# EasyEDA Pro project FPGA-G1.eprj, schematic Schematic1, sheets 7 to 10 of 10 (continued)
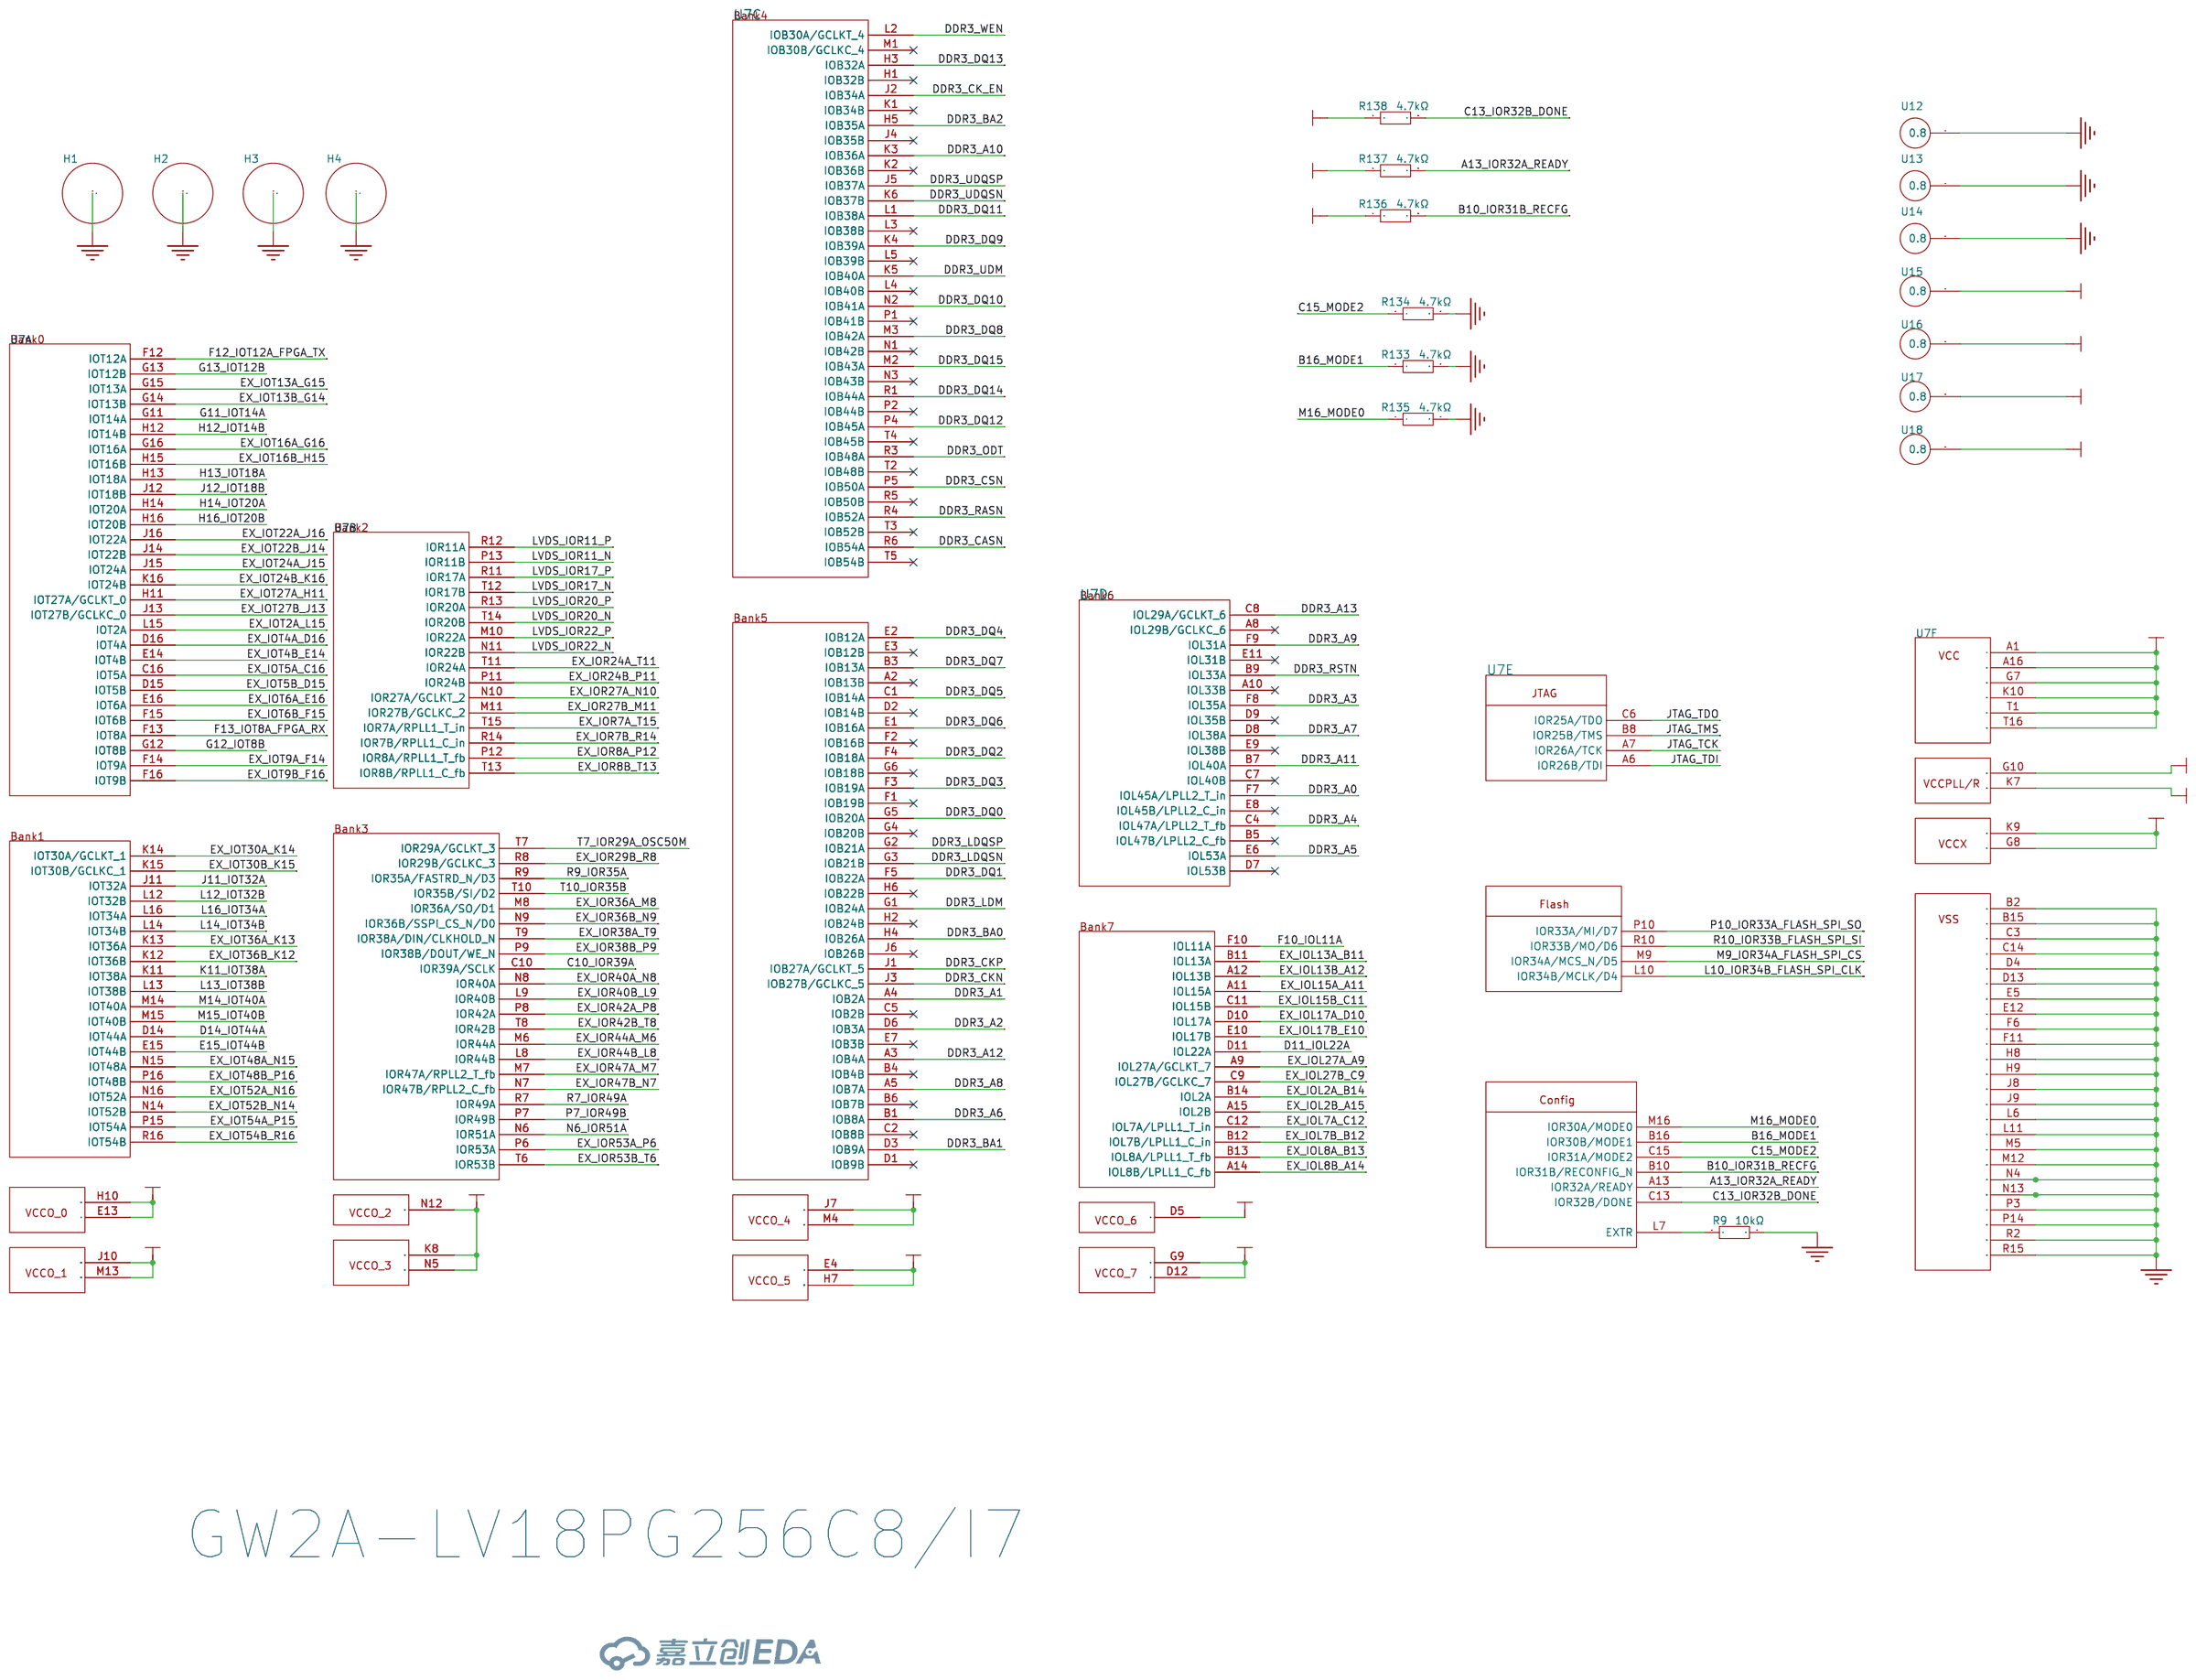
[diagram p0: FPGA]
## Library data of the parts
H5 H6 = 12251220ANG0S115001: 排数:双排;总PIN位数:40P;间距:2.54mm;插针结构:2x20P;行距:2.54mm;安装类型:直插;圆针/方针:方针;额定电流:3A;额定电压:-;配合针长度:6mm;塑高:2.5mm;端接针长度:3mm;触头材质:黄铜;触头镀层:-;工作温度范围:-40℃~+105℃;颜色:黑色;; LCSC Part Name: 2.54mm 2x20P 直插 方针; Supplier Part: C429965; Manufacturer: JILN(锦凌); Supplier Footprint: 插件,P=2.54mm; JLCPCB Part Class: 扩展库; Datasheet: https://atta.szlcsc.com/upload/public/pdf/source/20190920/C429965_BC46B4ED575BB92CEF1C6420E537C4AD.pdf; Supplier: LCSC; Number of Rows: 双排; Number of Pins: 40P; Pitch: 2.54mm; Pin Structure: 2x20P; Row Spacing: 2.54mm; Mounting Type: 直插; Circluar Pins/Square Pins: 方针; Current Rating (Max): 3A; Length of Mating Pin: 6mm; Insulation Height: 2.5mm; Length of End Connection Pin: 3mm; Contact Material: 黄铜; Operating Temperature Range: -40℃~+105℃; Color: 黑色
C22 C27 C91 C92 C114-C116 C118 C123 C124 C128 C132 C143-C147 C154-C159 C164-C173 = CL05B104KO5NNNC: 容值:100nF;精度:±10%;额定电压:16V;材质(温度系数):X7R;; LCSC Part Name: 100nF ±10% 16V; Supplier Part: C1525; Manufacturer: SAMSUNG(三星); Supplier Footprint: 0402; JLCPCB Part Class: 基础库; Datasheet: https://atta.szlcsc.com/upload/public/pdf/source/20160218/1457707763339.pdf; Supplier: LCSC; Tolerance: ±10%; Voltage Rated: 16V; Temperature Coefficient: X7R
CARD2 = TF PUSH: 卡类型:MicroSD卡(TF卡);连接器类型:卡座;卡连接方式:自弹式;本体最大高度:2mm;工作温度范围:-20℃~+90℃;; LCSC Part Name: 自弹式TF卡座 TF外焊式内存卡卡座; Supplier Part: C393941; Manufacturer: SHOU HAN(首韩); Supplier Footprint: SMD; JLCPCB Part Class: 扩展库; Datasheet: https://atta.szlcsc.com/upload/public/pdf/source/20191011/C393941_0DDD896EE907FEB750D8B7B8982E2A67.pdf; Supplier: LCSC; Card Type: MicroSD卡(TF卡); Connector Type: 卡座; Card Connection Mode: 自弹式; Maximum Body Height: 2mm; Operating Temperature Range: -20℃~+90℃
D11 = RCLAMP0524P_C907837: Supplier Part: C907837; Manufacturer: TECH PUBLIC(台舟); Supplier Footprint: DFN2510-10; JLCPCB Part Class: Extended Part; Datasheet: https://atta.szlcsc.com/upload/public/pdf/source/20210810/AE3DE9AC94AD2A317FD9BEA10653400F.pdf; Supplier: LCSC
C1 C2 = 0402CG180J500NT: 容值:18pF;精度:±5%;额定电压:50V;材质(温度系数):C0G;; LCSC Part Name: 18pF ±5% 50V; Supplier Part: C1549; Manufacturer: FH(风华); Supplier Footprint: 0402; JLCPCB Part Class: 基础库; Datasheet: https://atta.szlcsc.com/upload/public/pdf/source/20200305/C486355_26A10D38EF8C2A5C37091D0039909270.pdf; Supplier: LCSC; Tolerance: ±5%; Voltage Rated: 50V; Temperature Coefficient: C0G
CN1 = WAFER-100W-6A: 参考系列:-;间距:1mm;插针结构:1x6P;排数:1;每排PIN数:6;行距:-;公母:公型插针;安装方式:卧贴;额定电流:1A;工作温度范围:-25℃~+85℃;; LCSC Part Name: 间距:1mm 1x6P 卧贴; Supplier Part: C2874473; Manufacturer: HANBO(汉博); Supplier Footprint: SMD,P=1mm; JLCPCB Part Class: 扩展库; Datasheet: https://atta.szlcsc.com/upload/public/pdf/source/20221110/C17425B449CC0ADCA8915F66C4431F31.pdf; Supplier: LCSC; Pitch: 1mm; Pins Structure: 1x6P; Number of Rows: 1; Number of PINs Per Row: 6; Gender: 公型插针; Mounting Style: 卧贴; Current Rating (Max): 1A; Operating Temperature Range: -25℃~+85℃
D8 D12 E1 E2 = 0402ESDA-05N: 极性:双向;反向截止电压(Vrwm):5V;钳位电压(Vc)@Ipp:50V;; LCSC Part Name: 双向ESD; Supplier Part: C316049; Manufacturer: BORN(伯恩半导体); Supplier Footprint: 0402; JLCPCB Part Class: 扩展库; Datasheet: https://atta.szlcsc.com/upload/public/pdf/source/20181026/C316049_37ABAC87650F175221BFB473159300DE.pdf; Supplier: LCSC; Polarity: 双向; Reverse Stand-Off Voltage (Vrwm): 5V; Clamping Voltage@Ipp: 50V
FPC1 = FPC-05F-18PH20: 间距:0.5mm;触点数量:18P;锁定特性:翻盖式;安装类型:卧贴;触点类型:下接;工作温度范围:-25℃~+85℃;; LCSC Part Name: 0.5mm P数:18P 翻盖式 下接; Supplier Part: C2856802; Manufacturer: XUNPU(讯普); Supplier Footprint: SMD,P=0.5mm; JLCPCB Part Class: 扩展库; Datasheet: https://atta.szlcsc.com/upload/public/pdf/source/20210922/C2856802_2A845D1961F33AEC1ED22CECB292335F.pdf; Supplier: LCSC; Pitch: 0.5mm; Number of Contacts: 18P; Locking Feature: 翻盖式; Mounting Type: 卧贴; Contact Type: 下接; Height Above Board: 2mm; FFC, FCB Thickness: 0.3mm; Operating Temperature Range: -25℃~+85℃
LED1 = E6C0606RGBC3UDA: 发光颜色:RGB三色;; LCSC Part Name: RGB三色; Supplier Part: C375569; Manufacturer: ekinglux(亿晶源); Supplier Footprint: 0603; JLCPCB Part Class: Extended Part; Datasheet: https://atta.szlcsc.com/upload/public/pdf/source/20220330/8DE12FB9881A833E867FD7AF6894B416.pdf; Supplier: LCSC; Emitted Color: RGB三色
NC1 R2 R4 R6 = 0402WGF1002TCE: 电阻类型:厚膜电阻;阻值:10kΩ;精度:±1%;功率:62.5mW;温度系数:±100ppm/℃;; LCSC Part Name: 厚膜电阻 10kΩ ±1% 62.5mW; Supplier Part: C25744; Manufacturer: UNI-ROYAL(厚声); Supplier Footprint: 0402; JLCPCB Part Class: 基础库; Datasheet: https://atta.szlcsc.com/upload/public/pdf/source/20200306/C422600_1E6D84923E4A46A82E41ADD87F860B5C.pdf; Supplier: LCSC; Type: 厚膜电阻; Tolerance: ±1%; Power(Watts): 62.5mW; Temperature Coefficient: ±100ppm/℃; Overload Voltage (Max): 50V; Operating Temperature Range: -55℃~+155℃
Q1 = S8050 J3Y_C2146: 晶体管类型:NPN;集射极击穿电压(Vceo):25V;集电极电流(Ic):500mA;功率(Pd):300mW;直流电流增益(hFE@Ic,Vce):200@50mA,1V;; LCSC Part Name: NPN 耐压:25V 电流:500mA (200-350); Supplier Part: C2146; Manufacturer: CJ(江苏长电/长晶); Supplier Footprint: SOT-23; JLCPCB Part Class: 基础库; Datasheet: https://atta.szlcsc.com/upload/public/pdf/source/20140809/1457707209234.pdf; Supplier: LCSC; Transistor Type: NPN; Collector-Emitter Breakdown Voltage (Vceo): 25V; Collector Current (Ic): 500mA; Power Dissipation (Pd): 300mW; Collector Cut-Off Current (Icbo): 100nA; Collector-Emitter Saturation Voltage (VCE(sat)@Ic,Ib): 600mV@500mA,50mA; DC Current Gain (hFE@Ic,Vce): 200@50mA,1V; Transition Frequency (fT): 150MHz; Operating Temperature: +150℃@(Tj)
R1 = 0402WGF1004TCE: 电阻类型:厚膜电阻;阻值:1MΩ;精度:±1%;功率:62.5mW;温度系数:±100ppm/℃;; LCSC Part Name: 厚膜电阻 1MΩ ±1% 62.5mW; Supplier Part: C26083; Manufacturer: UNI-ROYAL(厚声); Supplier Footprint: 0402; JLCPCB Part Class: 基础库; Datasheet: https://atta.szlcsc.com/upload/public/pdf/source/20200306/C422600_1E6D84923E4A46A82E41ADD87F860B5C.pdf; Supplier: LCSC; Type: 厚膜电阻; Tolerance: ±1%; Power(Watts): 62.5mW; Temperature Coefficient: ±100ppm/℃; Overload Voltage (Max): 50V; Operating Temperature Range: -55℃~+155℃
R7 = 0402WGF100JTCE: 电阻类型:厚膜电阻;阻值:10Ω;精度:±1%;功率:62.5mW;温度系数:±200ppm/℃;; LCSC Part Name: 厚膜电阻 10Ω ±1% 62.5mW; Supplier Part: C25077; Manufacturer: UNI-ROYAL(厚声); Supplier Footprint: 0402; JLCPCB Part Class: 基础库; Datasheet: https://atta.szlcsc.com/upload/public/pdf/source/20200306/C422600_1E6D84923E4A46A82E41ADD87F860B5C.pdf; Supplier: LCSC; Type: 厚膜电阻; Tolerance: ±1%; Power(Watts): 62.5mW; Temperature Coefficient: ±200ppm/℃; Overload Voltage (Max): 50V; Operating Temperature Range: -55℃~+155℃
R8 = 0402WGF1001TCE: 电阻类型:厚膜电阻;阻值:1kΩ;精度:±1%;功率:62.5mW;; LCSC Part Name: 1kΩ ±1% 62.5mW; Supplier Part: C11702; Manufacturer: UNI-ROYAL(厚声); Supplier Footprint: 0402; JLCPCB Part Class: 基础库; Datasheet: https://atta.szlcsc.com/upload/public/pdf/source/20200306/C422600_1E6D84923E4A46A82E41ADD87F860B5C.pdf; Supplier: LCSC; Type: 厚膜电阻; Tolerance: ±1%; Power(Watts): 62.5mW; Temperature Coefficient: ±100ppm/℃; Overload Voltage (Max): 50V; Operating Temperature Range: -55℃~+155℃
R167 = 0402WGF3001TCE: 电阻类型:厚膜电阻;阻值:3kΩ;精度:±1%;功率:62.5mW;; LCSC Part Name: 3kΩ ±1% 62.5mW; Supplier Part: C25784; Manufacturer: UNI-ROYAL(厚声); Supplier Footprint: 0402; JLCPCB Part Class: Extended Part; Datasheet: https://atta.szlcsc.com/upload/public/pdf/source/20200306/C422600_1E6D84923E4A46A82E41ADD87F860B5C.pdf; Supplier: LCSC; Type: 厚膜电阻; Tolerance: ±1%; Power(Watts): 62.5mW; Temperature Coefficient: ±100ppm/℃; Overload Voltage (Max): 50V; Operating Temperature Range: -55℃~+155℃
R168 = 0402WGF4301TCE: 电阻类型:厚膜电阻;阻值:4.3kΩ;精度:±1%;功率:62.5mW;最大工作电压:50V;温度系数:±100ppm/℃;; LCSC Part Name: 4.3kΩ ±1% 62.5mW 厚膜电阻; Supplier Part: C25899; Manufacturer: UNI-ROYAL(厚声); Supplier Footprint: 0402; JLCPCB Part Class: 扩展库; Datasheet: https://atta.szlcsc.com/upload/public/pdf/source/20200306/C422600_1E6D84923E4A46A82E41ADD87F860B5C.pdf; Supplier: LCSC; Type: 厚膜电阻; Tolerance: ±1%; Power(Watts): 62.5mW; Overload Voltage (Max): 50V; Temperature Coefficient: ±100ppm/℃; Operating Temperature Range: -55℃~+155℃
R169 = 0402WGF9101TCE: 电阻类型:厚膜电阻;阻值:9.1kΩ;精度:±1%;功率:62.5mW;; LCSC Part Name: 9.1kΩ ±1% 62.5mW; Supplier Part: C25926; Manufacturer: UNI-ROYAL(厚声); Supplier Footprint: 0402; JLCPCB Part Class: Extended Part; Datasheet: https://atta.szlcsc.com/upload/public/pdf/source/20200306/C422600_1E6D84923E4A46A82E41ADD87F860B5C.pdf; Supplier: LCSC; Type: 厚膜电阻; Tolerance: ±1%; Power(Watts): 62.5mW; Temperature Coefficient: ±100ppm/℃; Overload Voltage (Max): 50V; Operating Temperature Range: -55℃~+155℃
SW1 = PTS815SJK250SMTRLFS: 电路结构:单刀单掷-常开;按钮形状:椭圆形按钮;作用力:250gf;安装方式:立贴;触点电流:50mA;额定电压(DC):12V;; LCSC Part Name: 轻触开关; Supplier Part: C918859; Manufacturer: C&K; Supplier Footprint: SMD; JLCPCB Part Class: Extended Part; Datasheet: https://atta.szlcsc.com/upload/public/pdf/source/20190916/C411883_4F77F16E1D8E48DC707D8949CEE7CF80.pdf; Supplier: LCSC; Circuit: 单刀单掷-常开; Actuator Style: 椭圆形按钮; Operating Force: 250gf; Mounting Style: 立贴; Contact Current: 50mA; Voltage Rating (DC): 12V; IP Rating: IP40; Pin Style: J型引脚; Operating Temperature: -20℃~+70℃
SW4 SW5 = B3U-1000P: 电路结构:单刀单掷;按钮形状:圆形按钮;作用力:153gf;安装方式:立贴;开关长度:3mm;开关宽度:2.5mm;开关高度:1.6mm;触点电流:50mA;额定电压(DC):12V;带灯:-;机械寿命:-;; LCSC Part Name: 3*2.5*1.6mm 立贴 轻触开关; Supplier Part: C231329; Manufacturer: OMRON(欧姆龙); Supplier Footprint: SMD,2.5x3mm; Supplier: LCSC; Circuit: 单刀单掷; Actuator Style: 圆形按钮; Operating Force: 153gf; Mounting Style: 立贴; Switch Length: 3mm; Switch Width: 2.5mm; Switch Height: 1.6mm; Contact Current: 50mA; Voltage Rating (DC): 12V; Pin Style: SMD接片; Operating Temperature: -25℃~+70℃
TP1-TP10 = Test-Point: Test Point 测试点
U1 = GD32F303CBT6_C3013779: CPU内核:ARM Cortex-M4;CPU最大主频:120MHz;工作电压范围:-;内部振荡器:-;外部时钟频率范围:-;程序 FLASH容量:128KB;RAM总容量:32KB;EEPROM/数据 FLASH容量:-;GPIO端口数量:37;ADC(单元数/通道数/位数):2@x10ch/12bit;DAC(单元数/通道数/位数):2@x12bit;(E)PWM(单元数/通道数/位数):-;8位Timer数量:-;16位Timer数量:7;32位Timer数量:-;内部比较器数量:-;U(S)ART; LCSC Part Name: ARM Cortex-M4 120MHz 闪存：128KB RAM：32KB; Supplier Part: C3013779; Manufacturer: GigaDevice(兆易创新); Supplier Footprint: LQFP-48; JLCPCB Part Class: 扩展库; Datasheet: https://atta.szlcsc.com/upload/public/pdf/source/20220624/E1A57ED816B162D6D1424864911A792F.pdf; Supplier: LCSC; CPU Core: ARM Cortex-M4; Maximum Frequency: 120MHz; Program FLASH Size: 128KB; RAM Size: 32KB; GPIO Ports Number: 37; ADC (Units/Channels/bits): 2@x10ch/12bit; DAC (Units/Channels/bits): 2@x12bit; 16Bit Timer Number: 7; U(S)ART Number: 3; I2C Number: 2; I2S Number: 2; (Q)SPI Number: 3; CAN Number: 1; Peripherals / Functions / Protocol Stacks: 看门狗；RTC实时时钟
X1 = X32258MOB4SI: 频率:8MHz;频率公差:±10ppm;负载电容:12pF;; LCSC Part Name: 8MHz ±10ppm 12pF YSX321SL; Supplier Part: C2682775; Manufacturer: YXC(扬兴晶振); Supplier Footprint: SMD3225-4P; JLCPCB Part Class: 扩展库; Datasheet: https://atta.szlcsc.com/upload/public/pdf/source/20210106/C2682774_0CD4FDA5D9DA3FBEEC23BD607A48E4B0.pdf; Supplier: LCSC; Crystal Type: 贴片无源晶振; Frequency Tolerance: ±10ppm; Frequency Stability: ±30ppm; Load Capacitance: 12pF; Equivalent Series Resistance (ESR): 150Ω; Operating Temperature: -40℃~+85℃
C117 C148-C150 C160 C161 = GRM188R61A226ME15D: 容值:22uF;精度:±20%;额定电压:10V;材质(温度系数):X5R;; LCSC Part Name: 22uF ±20% 10V; Supplier Part: C84419; Manufacturer: muRata(村田); Supplier Footprint: 0603; JLCPCB Part Class: 扩展库; Datasheet: https://atta.szlcsc.com/upload/public/pdf/source/20161024/1477288637384.pdf; Supplier: LCSC; Tolerance: ±20%; Voltage Rated: 10V; Temperature Coefficient: X5R
C126 C130 C151-C153 C162 C163 C180 C187 C194 = CL10A106KP8NNNC: 容值:10uF;精度:±10%;额定电压:10V;材质(温度系数):X5R;; LCSC Part Name: 10uF ±10% 10V; Supplier Part: C19702; Manufacturer: SAMSUNG(三星); Supplier Footprint: 0603; JLCPCB Part Class: 基础库; Datasheet: https://atta.szlcsc.com/upload/public/pdf/source/20160103/1457707703378.pdf; Supplier: LCSC; Tolerance: ±10%; Voltage Rated: 10V; Temperature Coefficient: X5R
C127 C131 = 0402B102K500NT: 容值:1nF;精度:±10%;额定电压:50V;材质(温度系数):X7R;; LCSC Part Name: 1nF ±10% 50V; Supplier Part: C1523; Manufacturer: FH(风华); Supplier Footprint: 0402; JLCPCB Part Class: 基础库; Datasheet: https://atta.szlcsc.com/upload/public/pdf/source/20200305/C486355_26A10D38EF8C2A5C37091D0039909270.pdf; Supplier: LCSC; Tolerance: ±10%; Voltage Rated: 50V; Temperature Coefficient: X7R
C174 C179 C181 C186 C188 C193 = CC0603KRX7R9BB104: 容值:100nF;精度:±10%;额定电压:50V;材质(温度系数):X7R;; LCSC Part Name: 100nF ±10% 50V; Supplier Part: C14663; Manufacturer: YAGEO(国巨); Supplier Footprint: 0603; JLCPCB Part Class: Basic Part; Datasheet: https://atta.szlcsc.com/upload/public/pdf/source/20170116/1484561234239.pdf; Supplier: LCSC; Tolerance: ±10%; Voltage Rated: 50V; Temperature Coefficient: X7R
C175 C176 C182 C183 C189 C190 = CL05B104KB54PNC: 容值:100nF;精度:±10%;额定电压:50V;材质(温度系数):X7R;; LCSC Part Name: 100nF ±10% 50V; Supplier Part: C307331; Manufacturer: SAMSUNG(三星); Supplier Footprint: 0402; JLCPCB Part Class: 基础库; Datasheet: https://atta.szlcsc.com/upload/public/pdf/source/20181009/C307331_222F7C870FD3EA5F46F538B483443886.pdf; Supplier: LCSC; Tolerance: ±10%; Voltage Rated: 50V; Temperature Coefficient: X7R
C177 C184 C191 = 0402CG220J500NT: 容值:22pF;精度:±5%;额定电压:50V;材质(温度系数):C0G;; LCSC Part Name: 22pF ±5% 50V; Supplier Part: C1555; Manufacturer: FH(风华); Supplier Footprint: 0402; JLCPCB Part Class: Basic Part; Datasheet: https://atta.szlcsc.com/upload/public/pdf/source/20170923/C1555_1506149269156988362.pdf; Supplier: LCSC; Tolerance: ±5%; Voltage Rated: 50V; Temperature Coefficient: C0G
C178 C185 C192 = CL10A226MQ8NRNC: 容值:22uF;精度:±20%;额定电压:6.3V;材质(温度系数):X5R;; LCSC Part Name: 22uF ±20% 6.3V; Supplier Part: C59461; Manufacturer: SAMSUNG(三星); Supplier Footprint: 0603; JLCPCB Part Class: Basic Part; Datasheet: https://atta.szlcsc.com/upload/public/pdf/source/20160103/1457707740762.pdf; Supplier: LCSC; Tolerance: ±20%; Voltage Rated: 6.3V; Temperature Coefficient: X5R
L2 L17 L18 = MWSA0402S-3R3MT: 额定电流:3.3A;精度:±20%;电感值:3.3uH;直流电阻(DCR):87mΩ;; LCSC Part Name: 3.3uH ±20%; Supplier Part: C408336; Manufacturer: Sunlord(顺络); Supplier Footprint: SMD; JLCPCB Part Class: Extended Part; Datasheet: https://atta.szlcsc.com/upload/public/pdf/source/20190729/C408336_17B5BB1DF2845DE8F323BD9CE9EEFEBA.pdf; Supplier: LCSC; Height: 2mm; Rated Current: 3.3A; Width: 4.4mm; Tolerance: ±20%; DC Resistance (DCR): 87mΩ; Length: 4.2mm
L12 L13 = UPZ1005D121-1R3TF: 标称阻抗@测试频率:120Ω@100MHz;误差:±25%;直流电阻(RDC):90mΩ;; LCSC Part Name: 单路 0402磁珠 阻抗120Ω@100MHz; Supplier Part: C96993; Manufacturer: Sunlord(顺络); Supplier Footprint: 0402; JLCPCB Part Class: 扩展库; Datasheet: https://atta.szlcsc.com/upload/public/pdf/source/20210916/3C06D8971A361A4569490E57F6B8A429.pdf; Supplier: LCSC; Impedance @ Frequency: 120Ω@100MHz; Tolerance: ±25%; DC Resistance: 90mΩ; Current Rating: 1.3A; Circuits: 1
R36 R157 R161 = 0402WGF4702TCE: 电阻类型:厚膜电阻;阻值:47kΩ;精度:±1%;功率:62.5mW;; LCSC Part Name: 47kΩ ±1% 62.5mW; Supplier Part: C25792; Manufacturer: UNI-ROYAL(厚声); Supplier Footprint: 0402; JLCPCB Part Class: Basic Part; Datasheet: https://atta.szlcsc.com/upload/public/pdf/source/20200306/C422600_1E6D84923E4A46A82E41ADD87F860B5C.pdf; Supplier: LCSC; Type: 厚膜电阻; Tolerance: ±1%; Power(Watts): 62.5mW; Temperature Coefficient: ±100ppm/℃; Overload Voltage (Max): 50V; Operating Temperature Range: -55℃~+155℃
R37 = 0402WGF1502TCE: 电阻类型:厚膜电阻;阻值:15kΩ;精度:±1%;功率:62.5mW;最大工作电压:50V;温度系数:±100ppm/℃;; LCSC Part Name: 15kΩ ±1% 62.5mW 厚膜电阻; Supplier Part: C25756; Manufacturer: UNI-ROYAL(厚声); Supplier Footprint: 0402; JLCPCB Part Class: 基础库; Datasheet: https://atta.szlcsc.com/upload/public/pdf/source/20200306/C422600_1E6D84923E4A46A82E41ADD87F860B5C.pdf; Supplier: LCSC; Type: 厚膜电阻; Tolerance: ±1%; Power(Watts): 62.5mW; Overload Voltage (Max): 50V; Temperature Coefficient: ±100ppm/℃; Operating Temperature Range: -55℃~+155℃
R40 = 0402WGF3301TCE: 电阻类型:厚膜电阻;阻值:3.3kΩ;精度:±1%;功率:62.5mW;最大工作电压:50V;温度系数:±100ppm/℃;; LCSC Part Name: 3.3kΩ ±1% 62.5mW 厚膜电阻; Supplier Part: C25890; Manufacturer: UNI-ROYAL(厚声); Supplier Footprint: 0402; JLCPCB Part Class: 基础库; Datasheet: https://atta.szlcsc.com/upload/public/pdf/source/20200306/C422600_1E6D84923E4A46A82E41ADD87F860B5C.pdf; Supplier: LCSC; Type: 厚膜电阻; Tolerance: ±1%; Power(Watts): 62.5mW; Overload Voltage (Max): 50V; Temperature Coefficient: ±100ppm/℃; Operating Temperature Range: -55℃~+155℃
R103 R104 = 0402WGF5101TCE: 电阻类型:厚膜电阻;阻值:5.1kΩ;精度:±1%;功率:62.5mW;温度系数:±100ppm/℃;; LCSC Part Name: 厚膜电阻 5.1kΩ ±1% 62.5mW; Supplier Part: C25905; Manufacturer: UNI-ROYAL(厚声); Supplier Footprint: 0402; JLCPCB Part Class: 基础库; Datasheet: https://atta.szlcsc.com/upload/public/pdf/source/20200306/C422600_1E6D84923E4A46A82E41ADD87F860B5C.pdf; Supplier: LCSC; Type: 厚膜电阻; Tolerance: ±1%; Power(Watts): 62.5mW; Temperature Coefficient: ±100ppm/℃; Overload Voltage (Max): 50V; Operating Temperature Range: -55℃~+155℃
R156 R158 R162 = RC0402FR-0730KL: 电阻类型:厚膜电阻;阻值:30kΩ;精度:±1%;功率:62.5mW;; LCSC Part Name: 30kΩ ±1% 62.5mW; Supplier Part: C138008; Manufacturer: YAGEO(国巨); Supplier Footprint: 0402; JLCPCB Part Class: Extended Part; Datasheet: https://atta.szlcsc.com/upload/public/pdf/source/20171107/C138008_15100516356731096935.pdf; Supplier: LCSC; Type: 厚膜电阻; Tolerance: ±1%; Power(Watts): 62.5mW; Temperature Coefficient: ±100ppm/℃; Overload Voltage (Max): 50V; Operating Temperature Range: -55℃~+155℃
R163 R165 = 0402WGF1202TCE: 电阻类型:厚膜电阻;阻值:12kΩ;精度:±1%;功率:62.5mW;最大工作电压:50V;温度系数:±100ppm/℃;; LCSC Part Name: 12kΩ ±1% 62.5mW 厚膜电阻; Supplier Part: C25752; Manufacturer: UNI-ROYAL(厚声); Supplier Footprint: 0402; JLCPCB Part Class: 基础库; Datasheet: https://atta.szlcsc.com/upload/public/pdf/source/20200306/C422600_1E6D84923E4A46A82E41ADD87F860B5C.pdf; Supplier: LCSC; Type: 厚膜电阻; Tolerance: ±1%; Power(Watts): 62.5mW; Overload Voltage (Max): 50V; Temperature Coefficient: ±100ppm/℃; Operating Temperature Range: -55℃~+155℃
R164 R166 = RC0402FR-0718KL: 电阻类型:厚膜电阻;阻值:18kΩ;精度:±1%;功率:62.5mW;最大工作电压:50V;温度系数:±100ppm/℃;; LCSC Part Name: 厚膜电阻 18kΩ ±1% 62.5mW; Supplier Part: C138044; Manufacturer: YAGEO(国巨); Supplier Footprint: 0402; JLCPCB Part Class: 扩展库; Datasheet: https://atta.szlcsc.com/upload/public/pdf/source/20181009/C309620_DA5935B6E1D48212CB7A533FE518B3C2.pdf; Supplier: LCSC; Type: 厚膜电阻; Tolerance: ±1%; Power(Watts): 62.5mW; Overload Voltage (Max): 50V; Temperature Coefficient: ±100ppm/℃; Operating Temperature Range: -55℃~+155℃
R177 = 0402WGF1501TCE: 电阻类型:厚膜电阻;阻值:1.5kΩ;精度:±1%;功率:62.5mW;温度系数:±100ppm/℃;; LCSC Part Name: 厚膜电阻 1.5kΩ ±1% 62.5mW; Supplier Part: C25867; Manufacturer: UNI-ROYAL(厚声); Supplier Footprint: 0402; JLCPCB Part Class: 基础库; Datasheet: https://atta.szlcsc.com/upload/public/pdf/source/20200306/C422600_1E6D84923E4A46A82E41ADD87F860B5C.pdf; Supplier: LCSC; Type: 厚膜电阻; Tolerance: ±1%; Power(Watts): 62.5mW; Temperature Coefficient: ±100ppm/℃; Overload Voltage (Max): 50V; Operating Temperature Range: -55℃~+155℃
U2 U31 U32 = SY8113BADC: 功能类型:降压型;同步整流:-;输出通道数:-;拓扑结构:-;输入电压:-;输出电流(最大值):-;开关频率:-;; LCSC Part Name: 降压型; Supplier Part: C78989; Manufacturer: silergy(矽力杰); Supplier Footprint: TSOT-23-6; JLCPCB Part Class: Extended Part; Datasheet: https://atta.szlcsc.com/upload/public/pdf/source/20161125/1480067827505.pdf; Supplier: LCSC; Function: 降压型
USB2 = TYPE-C 16PIN 2MD(073): 连接器类型:Type-C;标准:-;公母:母座;触点数量:16;端口数量:1;安装方式:卧贴;额定电流 - 电源:5A;工作温度范围:-25℃~+85℃;; LCSC Part Name: TYPE-C母座 16P 4脚插件带定位柱 不锈钢外壳 2次模顶; Supplier Part: C2765186; Manufacturer: SHOU HAN(首韩); Supplier Footprint: SMD; JLCPCB Part Class: 扩展库; Supplier: LCSC; Connector Type: Type-C; Gender: 母座; Number of Contacts: 16; Number of Ports: 1; Mounting Style: 卧贴; Current Rating - Power (Max): 5A; Operating Temperature Range: -25℃~+85℃

## Nets
+1.0V: C148.2 C149.2 C150.2 C151.2 C152.2 C153.2 C154.2 C155.2 C156.2 C157.2 C158.2 C159.2 C191.2 C192.2 C193.2 L12.1 L13.1 L18.2 R163.2 ; also on sheet 1
+1.5V: C27.2 C91.2 C92.2 C144.2 C145.2 C146.2 C147.2 C184.2 C185.2 C186.2 L17.2 R166.2 ; also on sheet 1 2 3
+3.3V: C22.2 C114.2 C115.2 C116.2 C123.2 C124.2 C143.2 C160.2 C161.2 C162.2 C163.2 C164.2 C165.2 C166.2 C168.2 C169.2 C170.2 C173.2 C177.2 C178.2 C179.2 CARD2.4(VDD) FPC1.10 H5.38 H6.38 L2.2 LED1.2(+) R2.2 R6.2 R7.2 R37.2 SW5.2 U1.1(VBAT) U1.9(VDDA) U1.24(VDD_1) U1.36(VDD_2) U1.48(VDD_3) ; also on sheet 1 3 4 5 6
+5V_IN: C117.2 C118.2 C171.2 C174.2 C180.2 C181.2 C187.2 C188.2 C194.2 CN1.6 D8.2 H5.40 H6.40 R36.2 R157.2 R161.2 U2.5(IN) U31.5(IN) U32.5(IN) USB2.2(VBUS) USB2.11(VBUS) ; also on sheet 1 4 5
GND: C1.2 C2.1 C22.1 C27.1 C91.1 C92.1 C114.1 C115.1 C116.1 C117.1 C118.1 C123.1 C124.1 C126.1 C127.1 C128.1 C130.1 C131.1 C132.1 C143.1 C144.1 C145.1 C146.1 C147.1 C148.1 C149.1 C150.1 C151.1 C152.1 C153.1 C154.1 C155.1 C156.1 C157.1 C158.1 C159.1 C160.1 C161.1 C162.1 C163.1 C164.1 C165.1 C166.1 C167.1 C168.1 C169.1 C170.1 C171.1 C172.1 C173.1 C174.1 C175.1 C178.1 C179.1 C180.1 C181.1 C182.1 C185.1 C186.1 C187.1 C188.1 C189.1 C192.1 C193.1 C194.1 CARD2.6(VSS) CARD2.10 CARD2.11 CARD2.12 CARD2.13 CN1.3 D8.1 D11.3(GND) D11.8(GND) D12.1 E1.1 E2.1 FPC1.11 FPC1.18 H5.37 H5.39 H6.37 H6.39 NC1.1 Q1.2(E) R4.1 R40.1 R103.2 R104.2 R156.1 R158.1 R162.1 R164.1 R165.1 SW1.3 SW1.4 SW4.1 U1.8(VSSA) U1.23(VSS_1) U1.35(VSS_2) U1.47(VSS_3) U2.2(GND) U31.2(GND) U32.2(GND) USB2.1(GND) USB2.12(GND) USB2.13(SHELL) USB2.14(SHELL) X1.2(GND) X1.4(GND) ; also on sheet 1 2 3 4 5 6
VCCPLLL: C126.2 C127.2 C128.2 L12.2 ; also on sheet 1
VCCPLLR: C130.2 C131.2 C132.2 L13.2 ; also on sheet 1
BOOT0: R4.2 SW5.1 U1.44(BOOT0)
D14_IOT44A: TP4.1 U1.13(PA3) ; also on sheet 1
E15_IOT44B: TP5.1 U1.14(PA4) ; also on sheet 1
EX_IOL2A_B14: H5.17 ; also on sheet 1
EX_IOL2B_A15: H5.18 ; also on sheet 1
EX_IOL7A_C12: H5.22 ; also on sheet 1
EX_IOL7B_B12: H5.21 ; also on sheet 1
EX_IOL8A_B13: H5.15 ; also on sheet 1
EX_IOL8B_A14: H5.16 ; also on sheet 1
EX_IOL13A_B11: H5.20 ; also on sheet 1
EX_IOL13B_A12: H5.19 ; also on sheet 1
EX_IOL15A_A11: H5.24 ; also on sheet 1
EX_IOL15B_C11: H5.23 ; also on sheet 1
EX_IOL17A_D10: H5.28 ; also on sheet 1
EX_IOL17B_E10: H5.27 ; also on sheet 1
EX_IOL27A_A9: H5.26 ; also on sheet 1
EX_IOL27B_C9: H5.25 ; also on sheet 1
EX_IOR7A_T15: H5.36 ; also on sheet 1
EX_IOR7B_R14: H5.35 ; also on sheet 1
EX_IOR8A_P12: H5.31 ; also on sheet 1
EX_IOR8B_T13: H5.33 ; also on sheet 1
EX_IOR24A_T11: H5.34 ; also on sheet 1
EX_IOR24B_P11: H5.32 ; also on sheet 1
EX_IOR27A_N10: H5.29 ; also on sheet 1
EX_IOR27B_M11: H5.30 ; also on sheet 1
EX_IOR29B_R8: H6.22 ; also on sheet 1
EX_IOR36A_M8: H6.16 ; also on sheet 1
EX_IOR36B_N9: H6.14 ; also on sheet 1
EX_IOR38A_T9: H6.23 ; also on sheet 1
EX_IOR38B_P9: H6.24 ; also on sheet 1
EX_IOR40A_N8: H6.20 ; also on sheet 1
EX_IOR40B_L9: H6.11 ; also on sheet 1
EX_IOR42A_P8: H6.26 ; also on sheet 1
EX_IOR42B_T8: H6.25 ; also on sheet 1
EX_IOR44A_M6: H6.15 ; also on sheet 1
EX_IOR44B_L8: H6.13 ; also on sheet 1
EX_IOR47A_M7: H6.17 ; also on sheet 1
EX_IOR47B_N7: H6.19 ; also on sheet 1
EX_IOR53A_P6: H6.21 ; also on sheet 1
EX_IOR53B_T6: H6.18 ; also on sheet 1
EX_IOT2A_L15: R177.2 ; also on sheet 1
EX_IOT4A_D16: H5.13 ; also on sheet 1
EX_IOT4B_E14: H5.14 ; also on sheet 1
EX_IOT5A_C16: H5.11 ; also on sheet 1
EX_IOT5B_D15: H5.12 ; also on sheet 1
EX_IOT6A_E16: H5.9 ; also on sheet 1
EX_IOT6B_F15: H5.10 ; also on sheet 1
EX_IOT9A_F14: H5.5 ; also on sheet 1
EX_IOT9B_F16: H5.6 ; also on sheet 1
EX_IOT13A_G15: H6.7 ; also on sheet 1
EX_IOT13B_G14: H6.8 ; also on sheet 1
EX_IOT16A_G16: H6.9 ; also on sheet 1
EX_IOT16B_H15: H6.10 ; also on sheet 1
EX_IOT22A_J16: H5.4 ; also on sheet 1
EX_IOT22B_J14: H5.3 ; also on sheet 1
EX_IOT24A_J15: H5.2 ; also on sheet 1
EX_IOT24B_K16: H5.1 ; also on sheet 1
EX_IOT27A_H11: H5.8 ; also on sheet 1
EX_IOT27B_J13: H5.7 ; also on sheet 1
EX_IOT30A_K14: H6.27 ; also on sheet 1
EX_IOT30B_K15: H6.28 ; also on sheet 1
EX_IOT36A_K13: H6.29 ; also on sheet 1
EX_IOT36B_K12: H6.30 ; also on sheet 1
EX_IOT48A_N15: H6.31 ; also on sheet 1
EX_IOT48B_P16: H6.32 ; also on sheet 1
EX_IOT52A_N16: H6.35 ; also on sheet 1
EX_IOT52B_N14: H6.36 ; also on sheet 1
EX_IOT54A_P15: H6.33 ; also on sheet 1
EX_IOT54B_R16: H6.34 ; also on sheet 1
EX_PA11: H6.2 U1.32(PA11)
EX_PA12: H6.1 U1.33(PA12)
EX_PB0: H6.5 U1.18(PB0)
EX_PB9: H6.6 U1.46(PB9)
EX_PB10: H6.4 U1.21(PB10)
EX_PB11: H6.3 U1.22(PB11)
J11_IOT32A: TP2.1 U1.11(PA1) ; also on sheet 1
J12_IOT18B: TP1.1 U1.10(PA0-WKUP) ; also on sheet 1
K11_IOT38A: TP3.1 U1.12(PA2) ; also on sheet 1
L12_IOT32B: TP6.1 U1.15(PA5) ; also on sheet 1
L13_IOT38B: TP7.1 U1.16(PA6) ; also on sheet 1
L16_IOT34A: TP8.1 U1.17(PA7) ; also on sheet 1
LCD_BLK: R8.2 U1.19(PB1)
LCD_CS: FPC1.14 U1.25(PB12)
LCD_DC: FPC1.15 U1.2(PC13-TAMPER-RTC)
LCD_MISO: FPC1.12 U1.27(PB14)
LCD_MOSI: FPC1.13 U1.28(PB15)
LCD_RST: FPC1.17 U1.20(PB2)
LCD_SCK: FPC1.16 U1.26(PB13)
M14_IOT40A: E2.2 R177.1 USB2.6(DP1) USB2.8(DP2) ; also on sheet 1
M15_IOT40B: E1.2 USB2.5(DN2) USB2.7(DN1) ; also on sheet 1
NRST: C167.2 R2.1 SW4.2 U1.7(NRST)
OSCIN: C1.1 R1.2 U1.5(PD0-OSCIN) X1.3
OSCOUT: C2.2 R1.1 U1.6(PD1-OSCOUT) X1.1
PA8: C172.2 D12.2 R6.1 SW1.1 SW1.2 U1.29(PA8)
PA9/USART0_TX: CN1.1 U1.30(PA9)
PA10/USART0_RX: CN1.2 U1.31(PA10)
PA13/SWDIO: CN1.4 TP9.1 U1.34(PA13)
PA14/SWCLK: CN1.5 TP10.1 U1.37(PA14)
PA15/SPI2_NSS: CARD2.2(CD/DAT3) D11.5(I/O4) D11.6(NC) U1.38(PA15)
PB3/SPI2_SCK: CARD2.5(CLX) D11.2(I/O2) D11.9(NC) U1.39(PB3)
PB4/SPI2_MISO: CARD2.7(DAT0) D11.1(I/O1) D11.10(NC) U1.40(PB4)
PB5/SPI2_MOSI: CARD2.3(CMD) D11.4(I/O3) D11.7(NC) U1.41(PB5)
PB6: R169.2 U1.42(PB6)
PB7: R167.1 U1.43(PB7)
PB8: R168.2 U1.45(PB8)
$7N2275: FPC1.9 R7.1
$7N2276: FPC1.5 FPC1.6 FPC1.7 FPC1.8 Q1.3(C)
$7N2277: NC1.2 Q1.1(B) R8.1
$7N2346: LED1.4(-) R167.2
$7N2347: LED1.1(-) R168.1
$7N2348: LED1.3(-) R169.1
$10N4043: R103.1 USB2.10(CC2)
$10N4048: R104.1 USB2.4(CC1)
$10N4103: C176.2 U2.1(BS)
$10N4104: C176.1 L2.1 U2.6(LX)
$10N4105: C177.1 R37.1 R40.2 U2.3(FB)
$10N4110: C175.2 R36.1 R156.2 U2.4(EN)
$10N4116: C183.2 U31.1(BS)
$10N4117: C183.1 L17.1 U31.6(LX)
$10N4118: C184.1 R165.2 R166.1 U31.3(FB)
$10N4123: C182.2 R157.1 R158.2 U31.4(EN)
$10N4129: C190.2 U32.1(BS)
$10N4130: C190.1 L18.1 U32.6(LX)
$10N4131: C191.1 R163.1 R164.2 U32.3(FB)
$10N4136: C189.2 R161.1 R162.2 U32.4(EN)

Not connected (* = marked no-connect by the designer): CARD2 1(DAT2)* 8(DAT1)* CD*; CN1 7* 8*; FPC1 1* 2* 3* 4* 19* 20*; H6 12*; U1 3(PC14-OSC32IN)* 4(PC15-OSC32OUT)*; USB2 3(SBU2)* 9(SBU1)*

## Notes on the sheets
sheet 7
- 晶振电路
- DAPLINK
- 红
- 绿
- 蓝
- GD32F303CBT6
- RGB灯
- 复位&启动电路
- 功能按键
- 与FPGA交互引脚
- 2.4寸TFT-SPI
sheet 8
- 重要事情说三遍！！！
- 重要事情说三遍！！！
- 只允许5V输入 3V3输出
- 只允许5V输入 3V3输出
- 只允许5V输入 3V3输出
- 只允许5V输入 3V3输出
- 只允许5V输入 3V3输出
- 只允许5V输入 3V3输出
- 拓展排针接口
sheet 10
- TYPE-16P
- BANK2&3
- BANK1
- BANK0
- BANK7
- BANK5&6
- BANK4
- FPGA主电源滤波
- 后续请勿更新库，相关管脚会修改。
- 后续请勿更新库，相关管脚会修改。
- Vout = 0.6 * (1 +  R163/R164 )
- 主控电源部分
- 后续请勿更新库，相关管脚会修改。
